# EasyEDA Pro project PRO_project.eprj, schematic Schematic1_1 (continued)
## Sheets (continued)
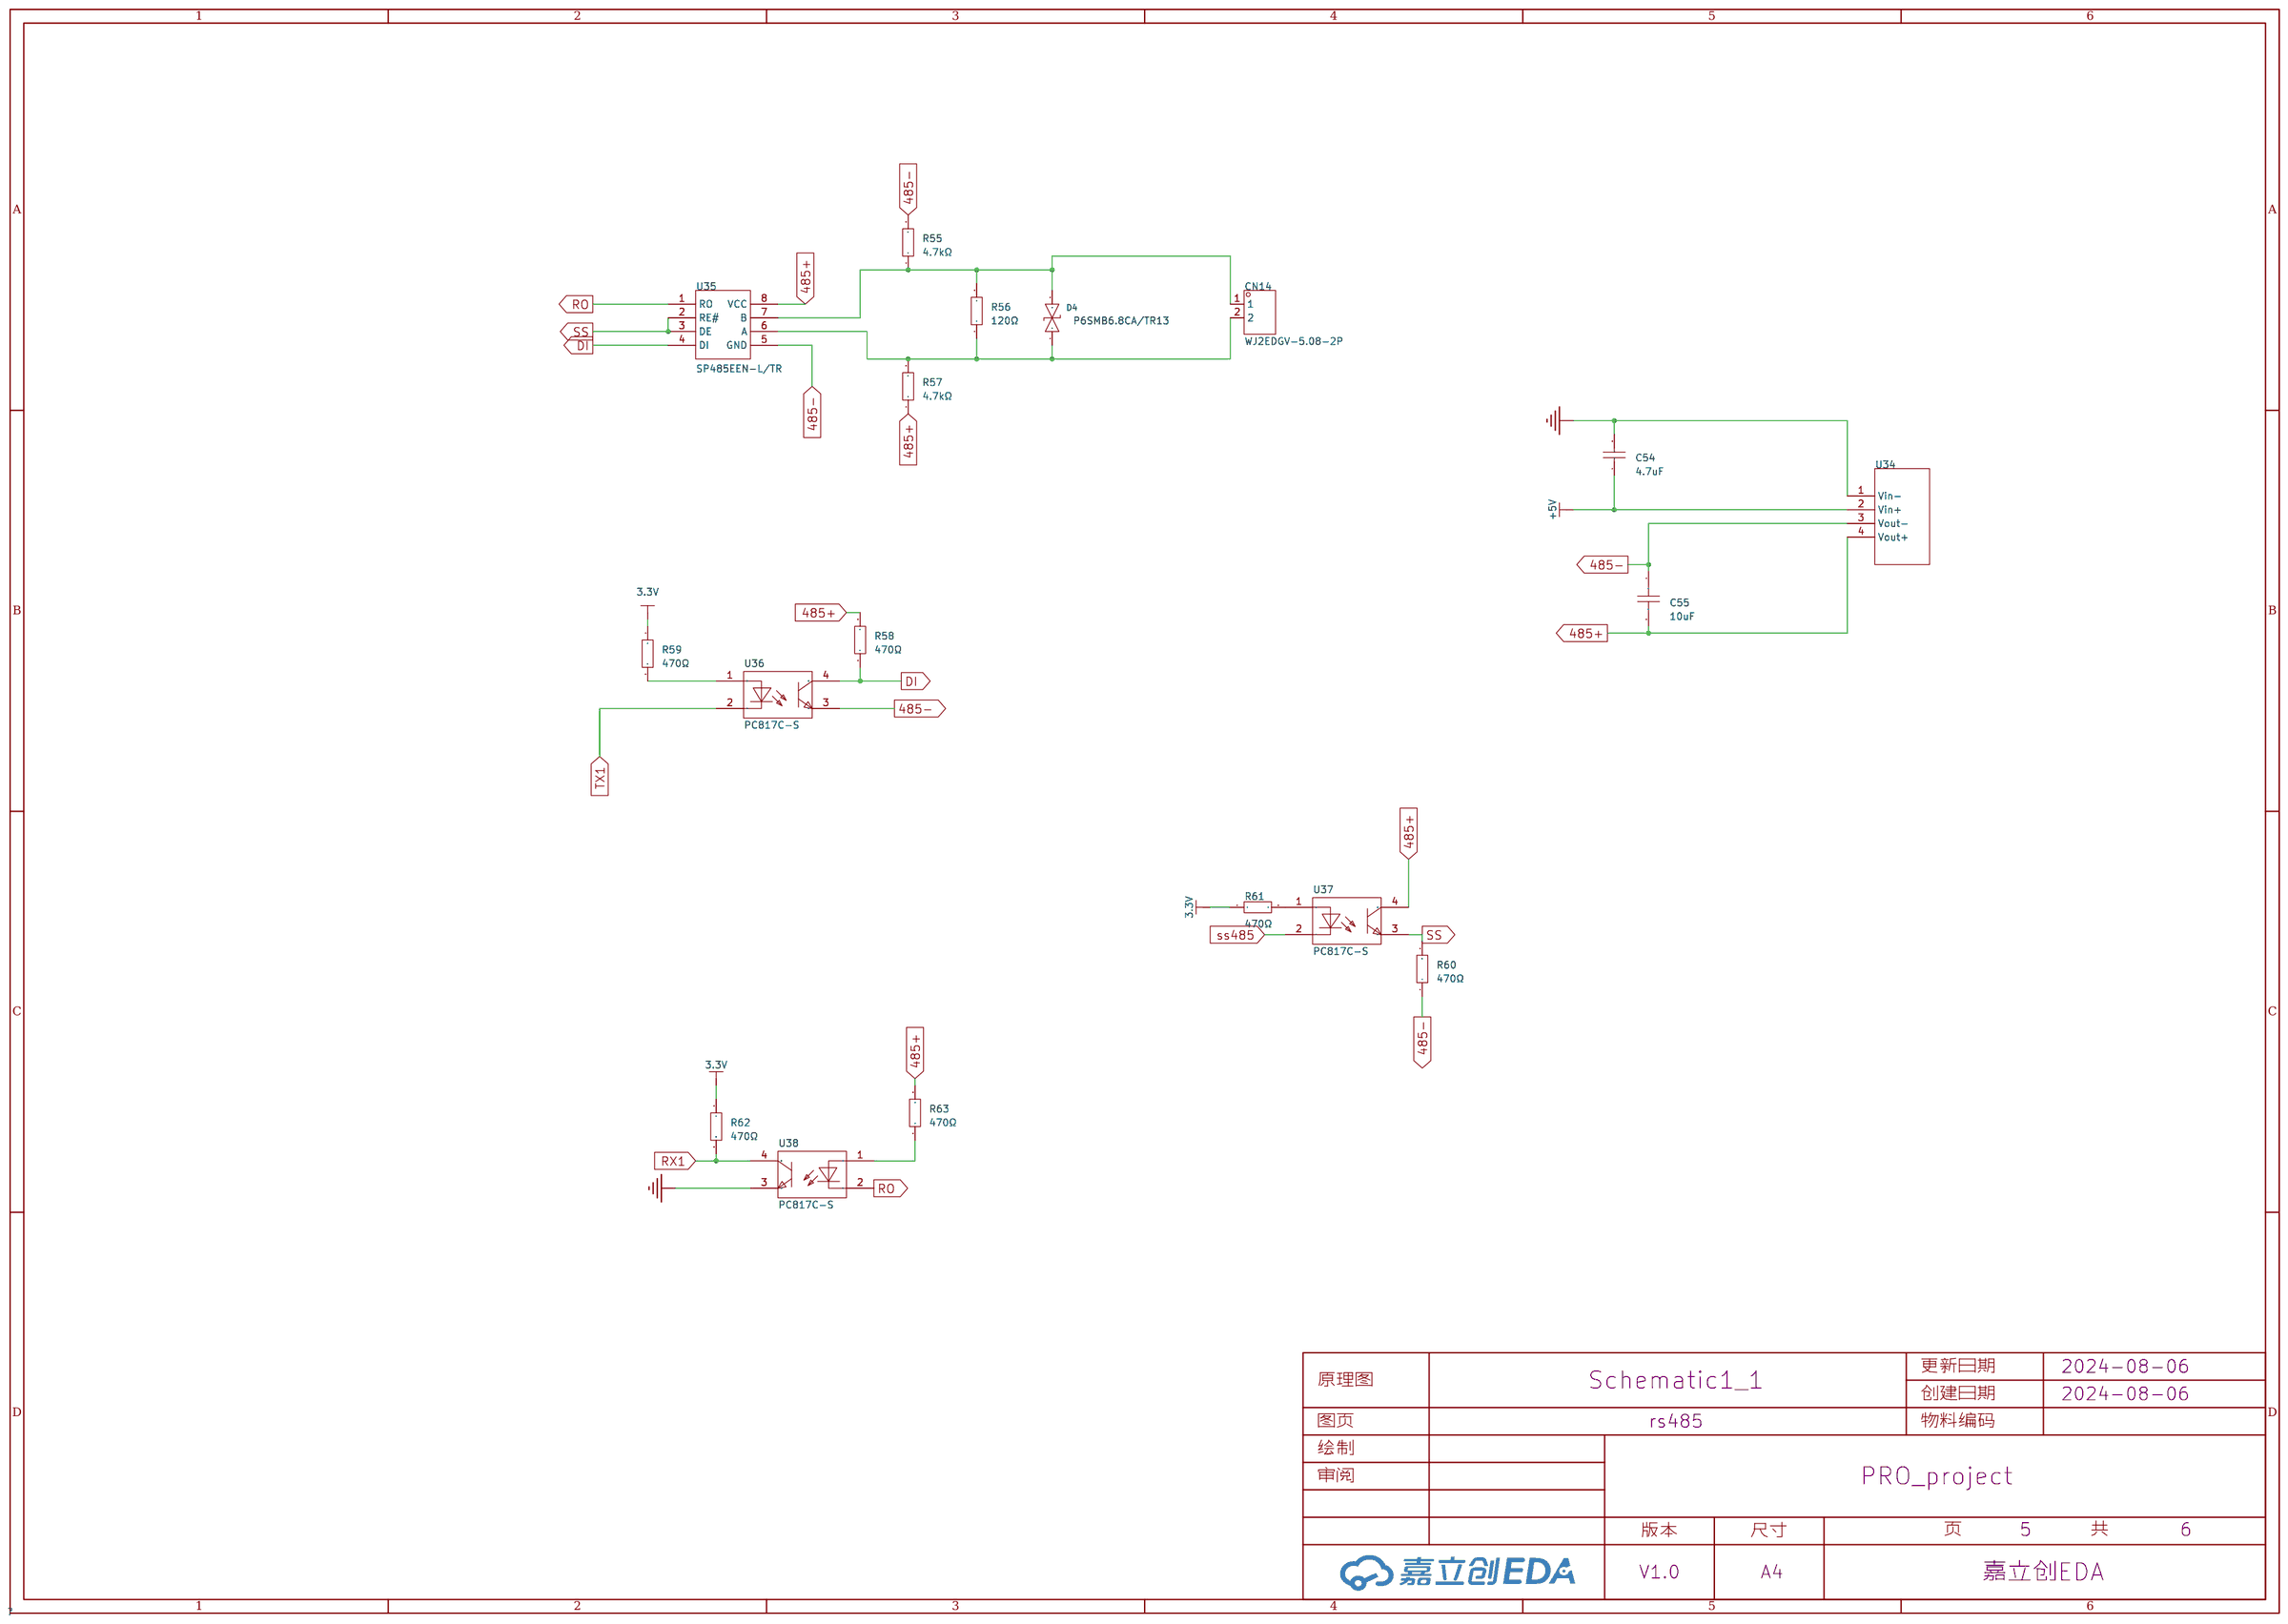
[diagram p10: rs485]
5 ADC: Page Name: ADC; Update Date: 2024-07-26
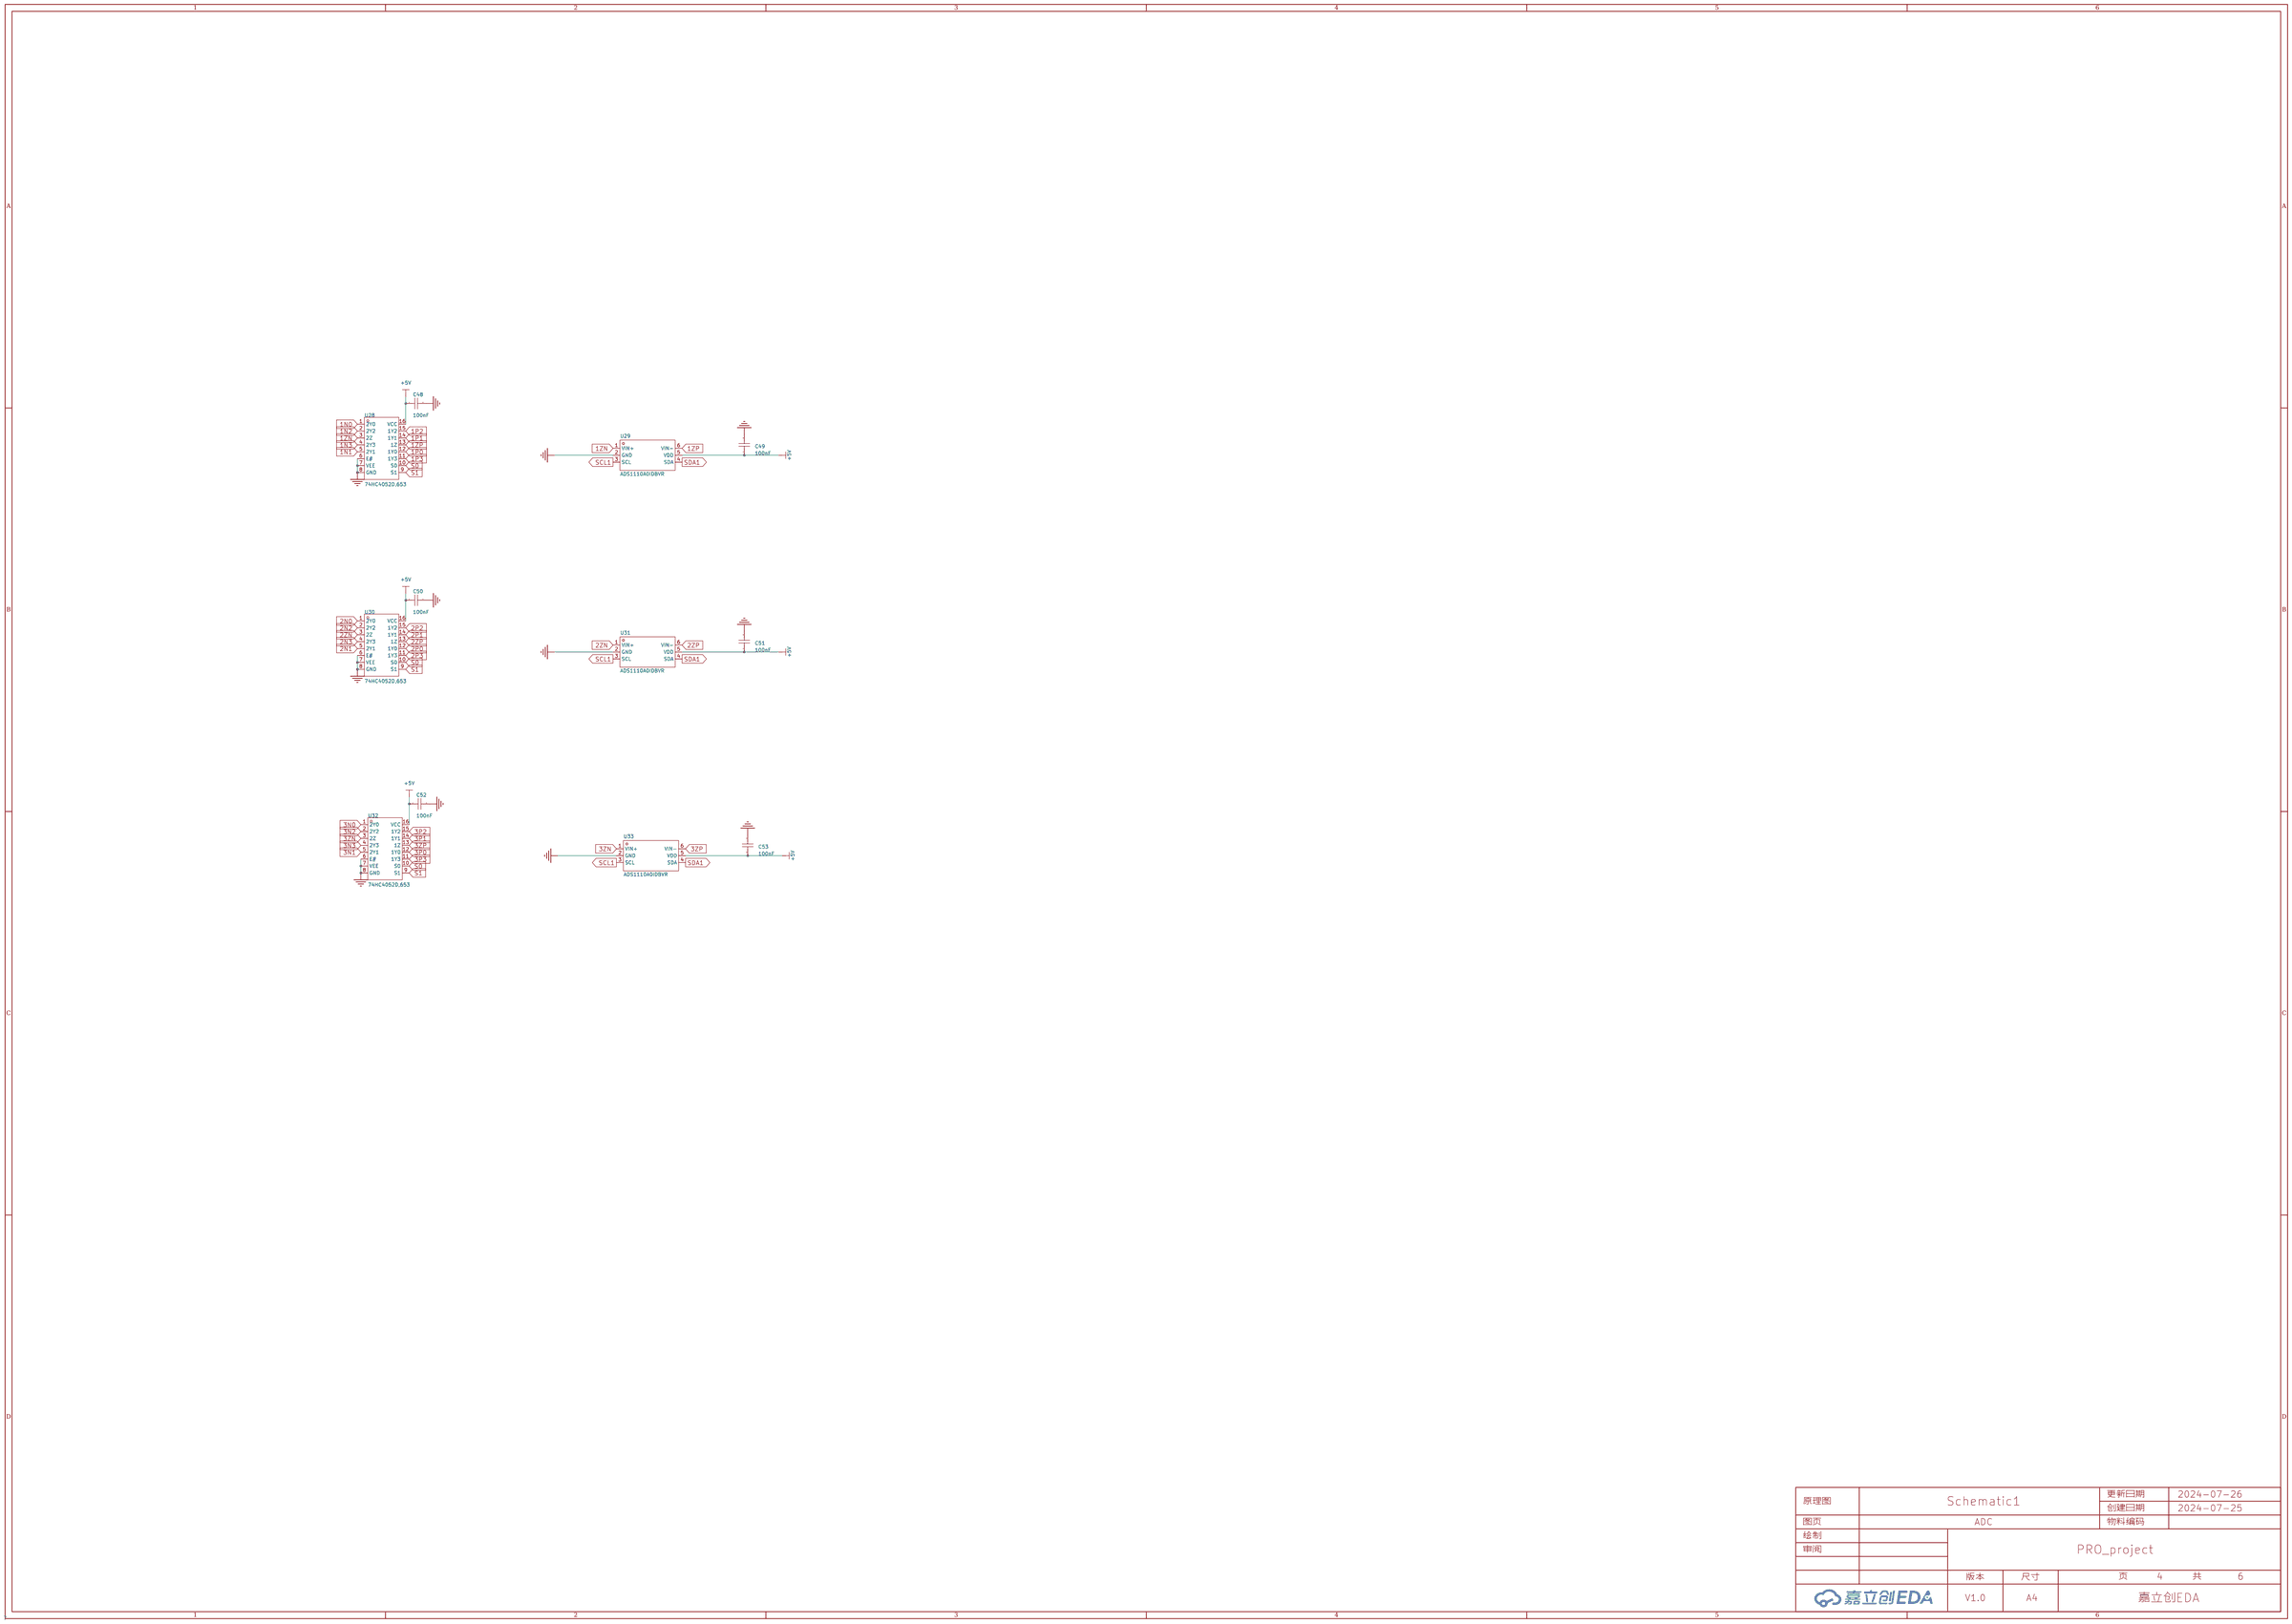
[diagram p11: ADC]
6 CAN: Create Date: 2024-07-26; Page Name: CAN; Update Date: 2024-07-26
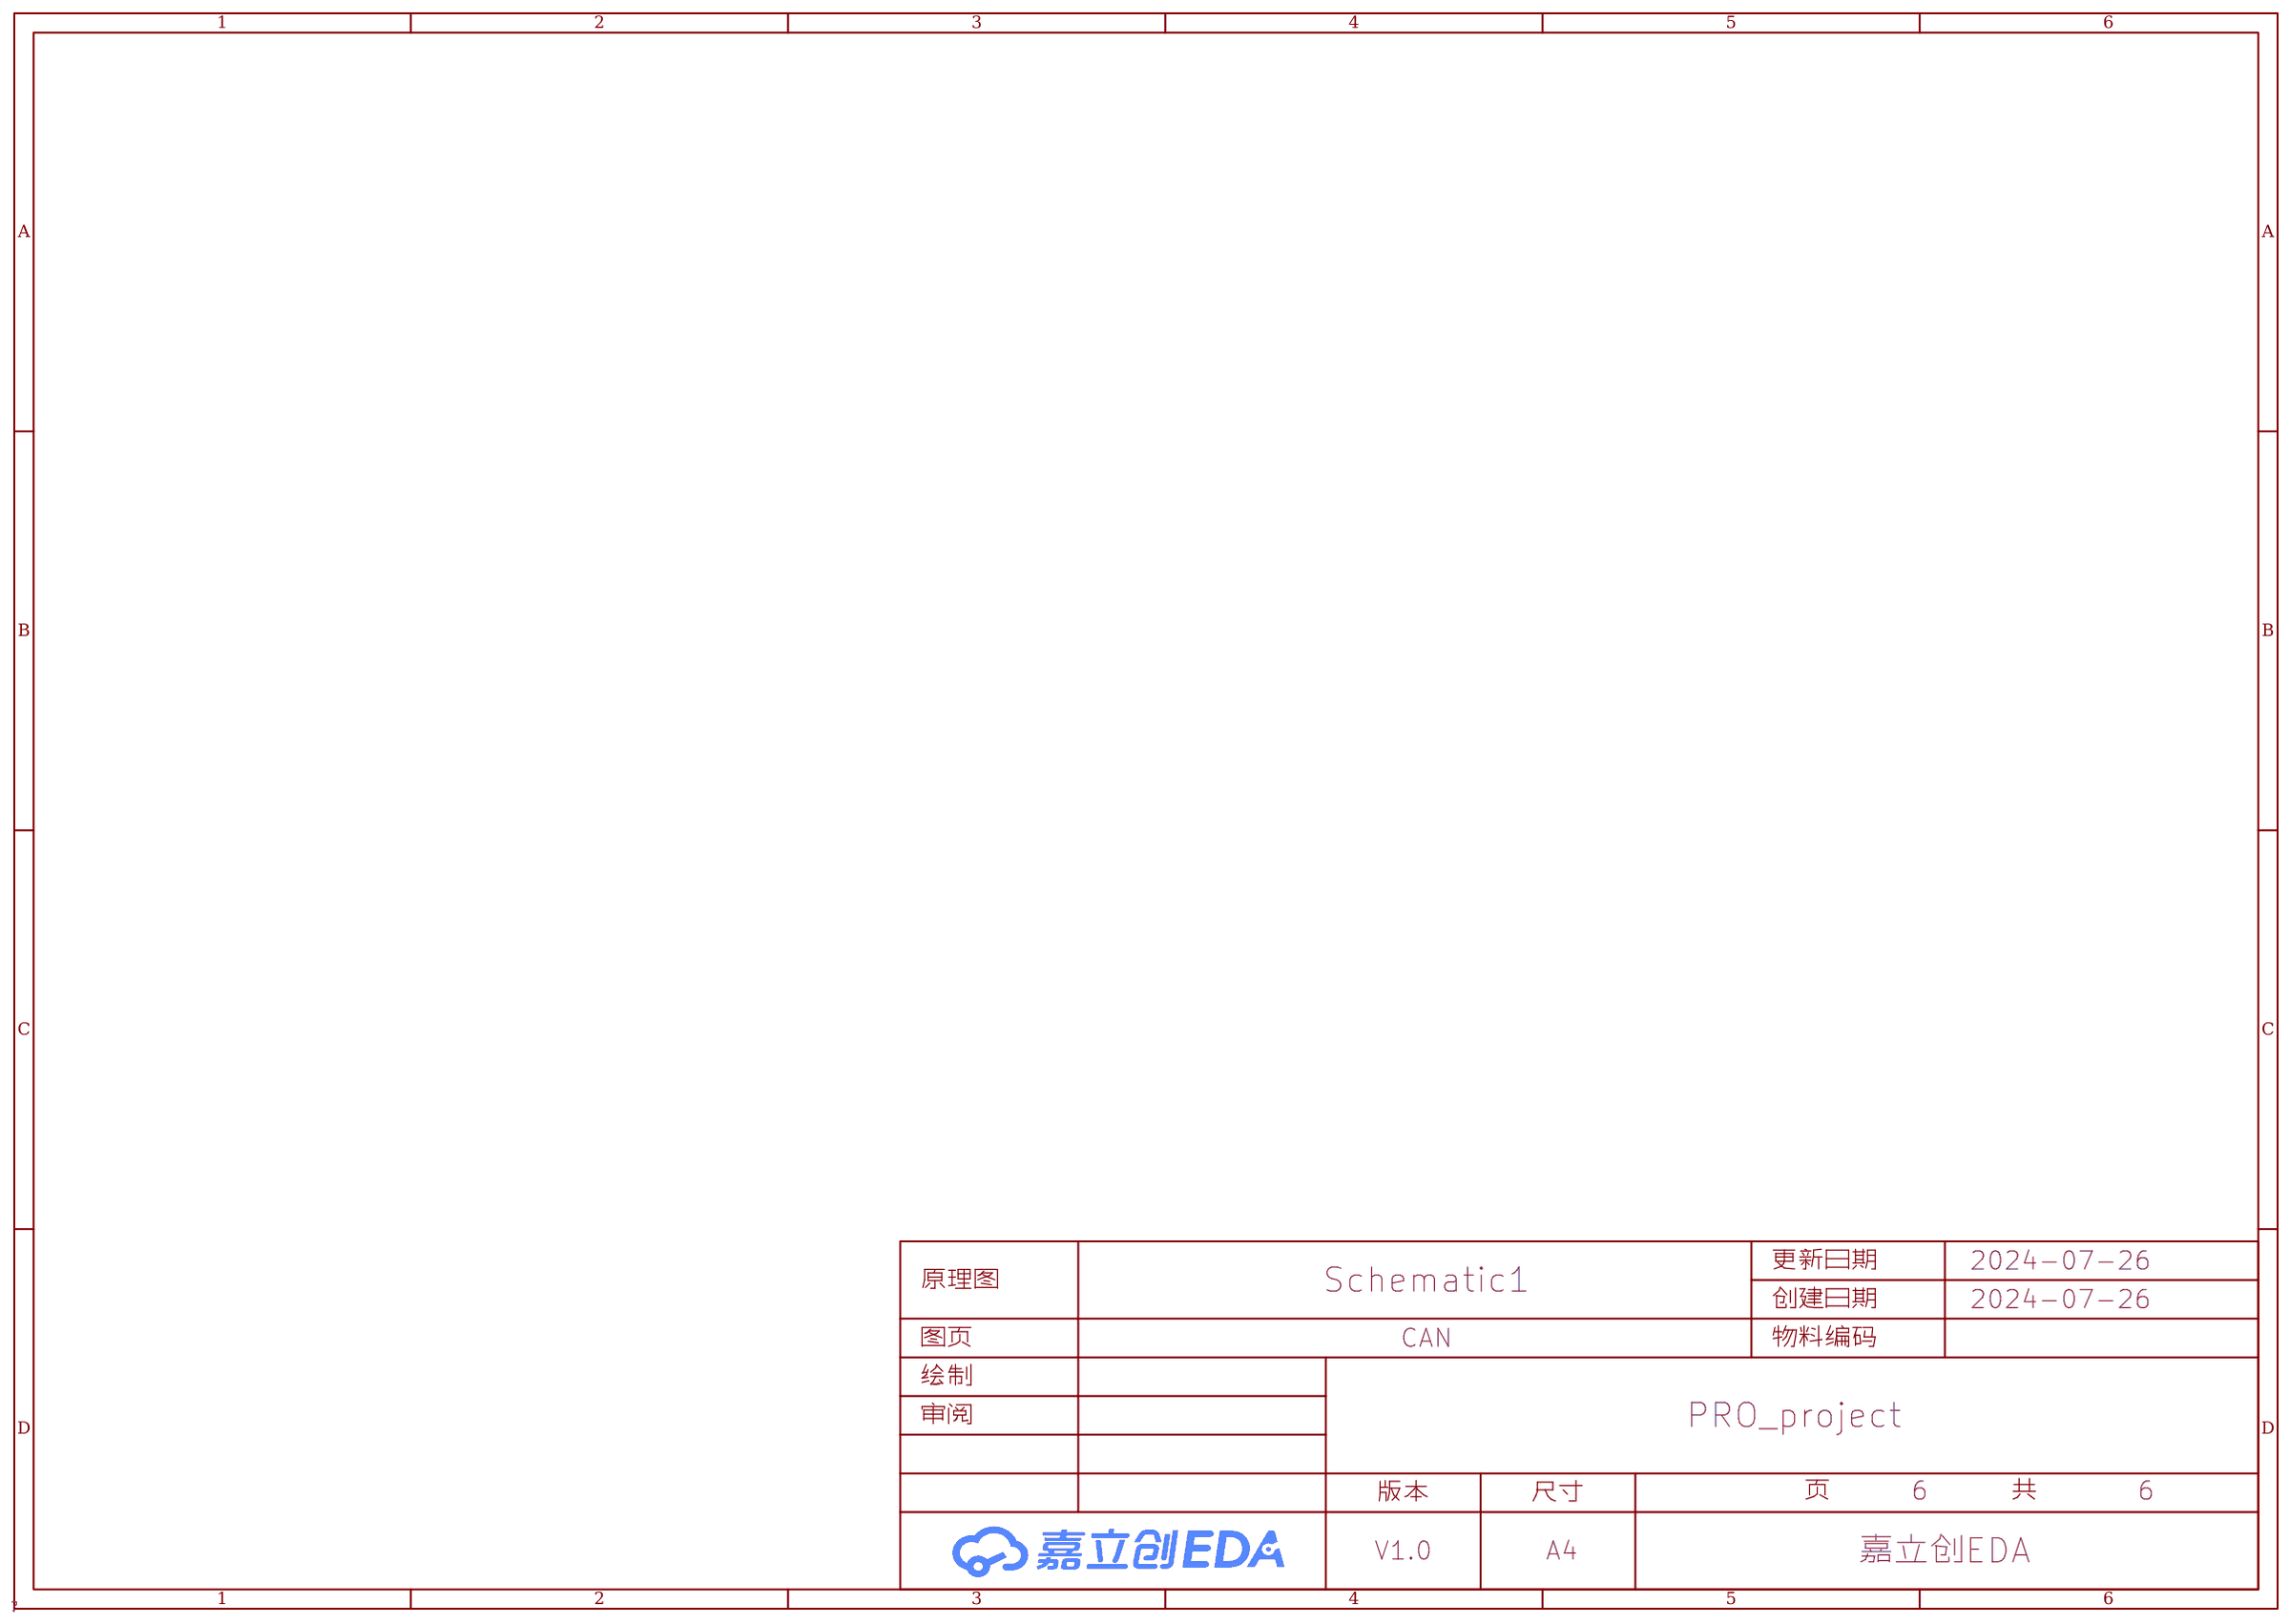
[diagram p12: CAN]

## Parts
sheet 74H
C12  330pF  [C0603]
C13  330pF  [C0603]
C14  330pF  [C0603]
C15  330pF  [C0603]
C16  10uF  [C0603]
C17  10uF  [C0603]
C18  10uF  [C0603]
C19  10uF  [C0603]
C20  4.7uF  [C0603]
C21  4.7uF  [C0603]
C22  4.7uF  [C0603]
C23  4.7uF  [C0603]
C24  330pF  [C0603]
C25  330pF  [C0603]
C26  330pF  [C0603]
C27  330pF  [C0603]
C28  10uF  [C0603]
C29  10uF  [C0603]
C30  10uF  [C0603]
C31  10uF  [C0603]
C32  4.7uF  [C0603]
C33  4.7uF  [C0603]
C34  4.7uF  [C0603]
C35  4.7uF  [C0603]
C36  330pF  [C0603]
C37  330pF  [C0603]
C38  330pF  [C0603]
C39  330pF  [C0603]
C40  10uF  [C0603]
C41  10uF  [C0603]
C42  10uF  [C0603]
C43  10uF  [C0603]
C44  4.7uF  [C0603]
C45  4.7uF  [C0603]
C46  4.7uF  [C0603]
C47  4.7uF  [C0603]
CN2  WJ2EDGV-5.08-2P  [CONN-TH_WJ2EDGV-5.08-2P]
CN3  WJ2EDGV-5.08-2P  [CONN-TH_WJ2EDGV-5.08-2P]
CN4  WJ2EDGV-5.08-2P  [CONN-TH_WJ2EDGV-5.08-2P]
CN5  WJ2EDGV-5.08-2P  [CONN-TH_WJ2EDGV-5.08-2P]
CN6  WJ2EDGV-5.08-2P  [CONN-TH_WJ2EDGV-5.08-2P]
CN7  WJ2EDGV-5.08-2P  [CONN-TH_WJ2EDGV-5.08-2P]
CN8  WJ2EDGV-5.08-2P  [CONN-TH_WJ2EDGV-5.08-2P]
CN9  WJ2EDGV-5.08-2P  [CONN-TH_WJ2EDGV-5.08-2P]
CN10  WJ2EDGV-5.08-2P  [CONN-TH_WJ2EDGV-5.08-2P]
CN11  WJ2EDGV-5.08-2P  [CONN-TH_WJ2EDGV-5.08-2P]
CN12  WJ2EDGV-5.08-2P  [CONN-TH_WJ2EDGV-5.08-2P]
CN13  WJ2EDGV-5.08-2P  [CONN-TH_WJ2EDGV-5.08-2P]
R7  82kΩ  [R0805]
R8  82kΩ  [R0805]
R9  82kΩ  [R0805]
R10  82kΩ  [R0805]
R11  82kΩ  [R0805]
R12  82kΩ  [R0805]
R13  82kΩ  [R0805]
R14  82kΩ  [R0805]
R15  3.24kΩ  [R0805]
R16  3.24kΩ  [R0805]
R17  3.24kΩ  [R0805]
R18  3.24kΩ  [R0805]
R19  3.24kΩ  [R0805]
R20  3.24kΩ  [R0805]
R21  3.24kΩ  [R0805]
R22  3.24kΩ  [R0805]
R23  82kΩ  [R0805]
R24  82kΩ  [R0805]
R25  82kΩ  [R0805]
R26  82kΩ  [R0805]
R27  82kΩ  [R0805]
R28  82kΩ  [R0805]
R29  82kΩ  [R0805]
R30  82kΩ  [R0805]
R31  3.24kΩ  [R0805]
R32  3.24kΩ  [R0805]
R33  3.24kΩ  [R0805]
R34  3.24kΩ  [R0805]
R35  3.24kΩ  [R0805]
R36  3.24kΩ  [R0805]
R37  3.24kΩ  [R0805]
R38  3.24kΩ  [R0805]
R39  82kΩ  [R0805]
R40  82kΩ  [R0805]
R41  82kΩ  [R0805]
R42  82kΩ  [R0805]
R43  82kΩ  [R0805]
R44  82kΩ  [R0805]
R45  82kΩ  [R0805]
R46  82kΩ  [R0805]
R47  3.24kΩ  [R0805]
R48  3.24kΩ  [R0805]
R49  3.24kΩ  [R0805]
R50  3.24kΩ  [R0805]
R51  3.24kΩ  [R0805]
R52  3.24kΩ  [R0805]
R53  3.24kΩ  [R0805]
R54  3.24kΩ  [R0805]
U4  AMC1200BDWVR  [SOIC-8_L5.9-W7.5-P1.27-LS11.5-BL]
U5  AMC1200BDWVR  [SOIC-8_L5.9-W7.5-P1.27-LS11.5-BL]
U6  AMC1200BDWVR  [SOIC-8_L5.9-W7.5-P1.27-LS11.5-BL]
U7  AMC1200BDWVR  [SOIC-8_L5.9-W7.5-P1.27-LS11.5-BL]
U8  -  [iCash-B0505-Right]
U9  -  [iCash-B0505-Right]
U10  -  [iCash-B0505-Right]
U11  -  [iCash-B0505-Right]
U12  AMC1200BDWVR  [SOIC-8_L5.9-W7.5-P1.27-LS11.5-BL]
U13  AMC1200BDWVR  [SOIC-8_L5.9-W7.5-P1.27-LS11.5-BL]
U14  AMC1200BDWVR  [SOIC-8_L5.9-W7.5-P1.27-LS11.5-BL]
U15  AMC1200BDWVR  [SOIC-8_L5.9-W7.5-P1.27-LS11.5-BL]
U16  -  [iCash-B0505-Right]
U17  -  [iCash-B0505-Right]
U18  -  [iCash-B0505-Right]
U19  -  [iCash-B0505-Right]
U20  AMC1200BDWVR  [SOIC-8_L5.9-W7.5-P1.27-LS11.5-BL]
U21  AMC1200BDWVR  [SOIC-8_L5.9-W7.5-P1.27-LS11.5-BL]
U22  AMC1200BDWVR  [SOIC-8_L5.9-W7.5-P1.27-LS11.5-BL]
U23  AMC1200BDWVR  [SOIC-8_L5.9-W7.5-P1.27-LS11.5-BL]
U24  -  [iCash-B0505-Right]
U25  -  [iCash-B0505-Right]
U26  -  [iCash-B0505-Right]
U27  -  [iCash-B0505-Right]
sheet ADC
C48  100nF  [C0402]
C49  100nF  [C0402]
C50  100nF  [C0402]
C51  100nF  [C0402]
C52  100nF  [C0402]
C53  100nF  [C0402]
U28  74HC4052D,653  [SOIC-16_L9.9-W3.9-P1.27-LS6.0-BL]
U29  ADS1110A0IDBVR  [SOT-23-6_L2.9-W1.6-P0.95-LS2.8-BR]
U30  74HC4052D,653  [SOIC-16_L9.9-W3.9-P1.27-LS6.0-BL]
U31  ADS1110A0IDBVR  [SOT-23-6_L2.9-W1.6-P0.95-LS2.8-BR]
U32  74HC4052D,653  [SOIC-16_L9.9-W3.9-P1.27-LS6.0-BL]
U33  ADS1110A0IDBVR  [SOT-23-6_L2.9-W1.6-P0.95-LS2.8-BR]
sheet mcu
C5  22pF  [C0805]
C6  22pF  [C0805]
C7  100nF  [C0402]
C8  10uF  [C0603]
C9  100nF  [C0402]
C10  100nF  [C0402]
C11  100nF  [C0402]
H1  PZ254V-11-02P  [HDR-TH_2P-P2.54-V-M]
H2  PZ254V-11-04P  [HDR-TH_4P-P2.54-V-M]
H3  PZ254V-11-02P  [HDR-TH_2P-P2.54-V-M]
H4  2.54-1*3P针  [HDR-TH_3P-P2.54-V-M-1]
L3  GZ1608D601TF  [L0603]
R1  1MΩ  [R0603]
R2  10kΩ  [R0402]
R3  10kΩ  [R0402]
R4  10kΩ  [R0603]
R5  10kΩ  [R0603]
R6  10kΩ  [R0402]
SCREW1  -  [M3螺丝]
SCREW2  -  [M3螺丝]
SCREW3  -  [M3螺丝]
SCREW4  -  [M3螺丝]
U3  STM32F103C8T6  [LQFP-48_L7.0-W7.0-P0.50-LS9.0-BL]
X1  8MHz  [HC-49US_L11.5-W4.5-P4.88]
sheet power
C1  680uF  [CAP-TH_BD12.5-P5.00-D0.6-FD]
C2  220uF  [CAP-TH_BD6.3-P2.50-D1.0-FD]
C3  220uF  [CAP-TH_BD6.3-P2.50-D1.0-FD]
C4  100nF  [C0402]
CN1  WJ2EDGV-5.08-2P  [CONN-TH_WJ2EDGV-5.08-2P]
D1  US1M  [SMA_L4.4-W2.8-LS5.4-RD]